# EasyEDA Pro project kuafu01_030内部老化方案.eprj, board PCB4 (continued)
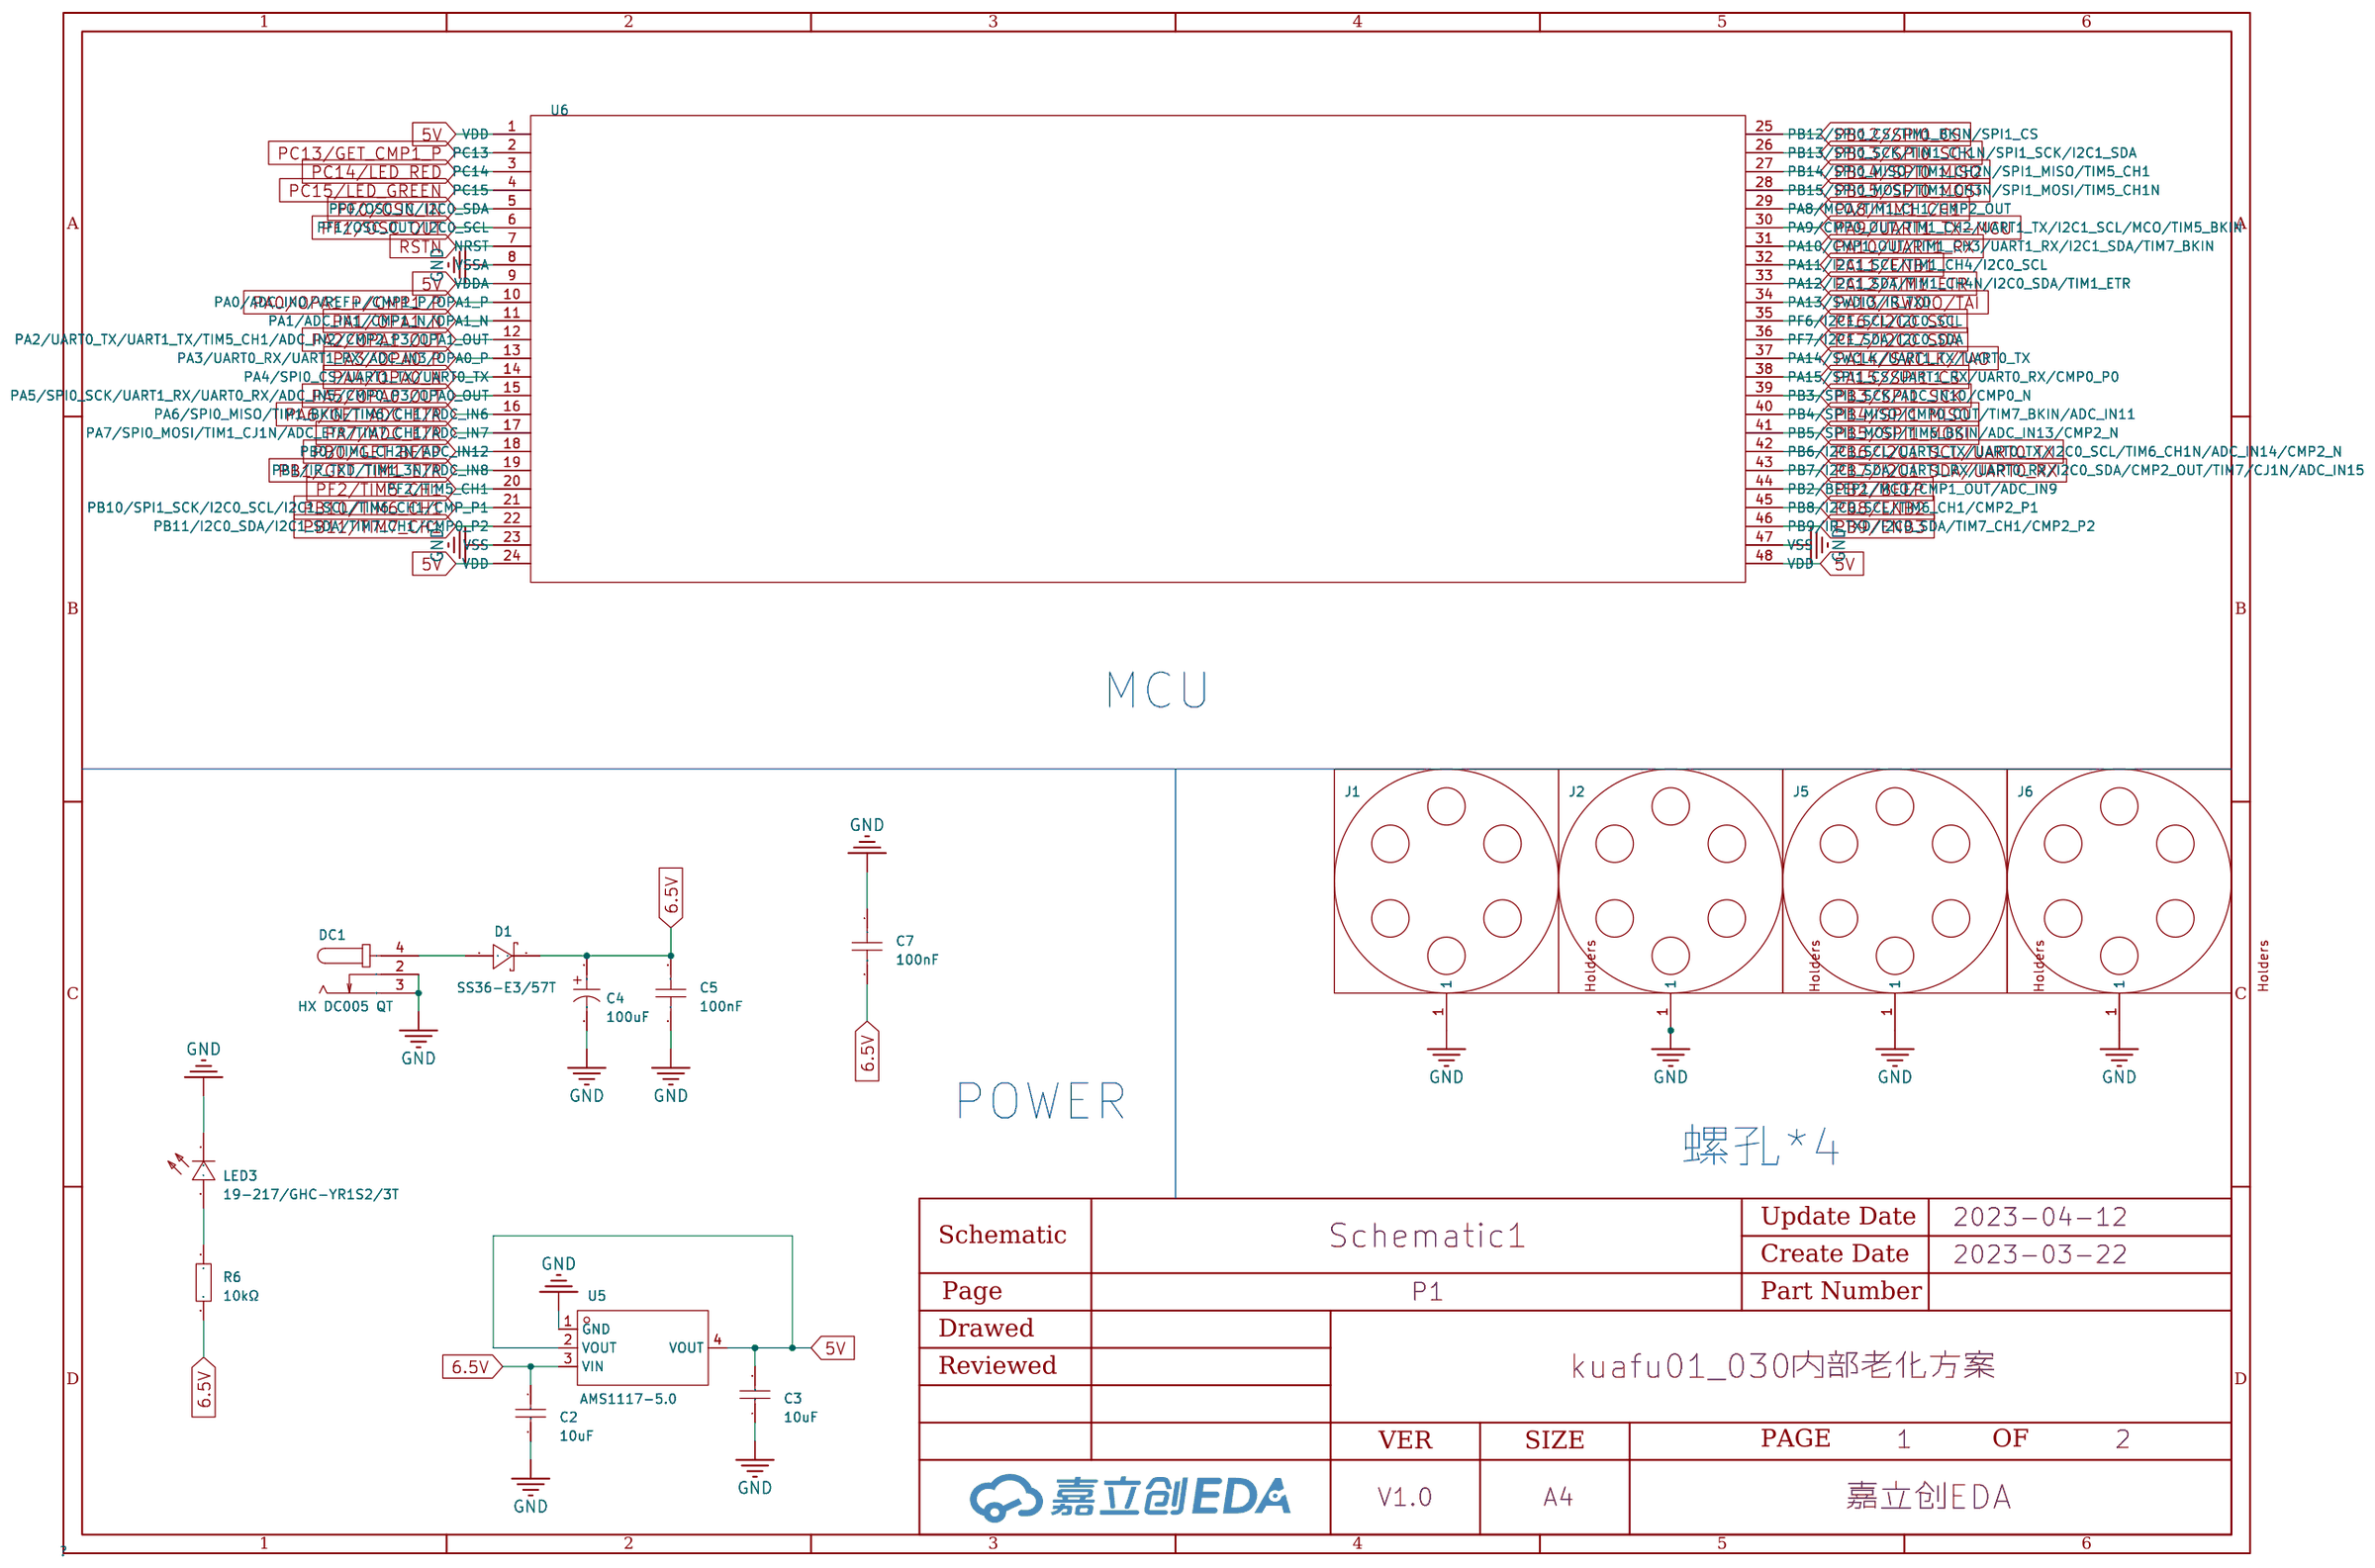
[diagram p0: P1]
## Routing (per net, layer and track width the routed paths; a pad name or vN(x,y) marks a point on that pad's centre or on a via; arc(x,y) is an arc through that point) (continued)
PA0/OPA1_P/CMP1_P: length 689
  Top Layer w0.254: 98.3,126.62 94.39,126.62 v1(92.8,125.03) ; v1(292.97,219.9) 292.45,220.41 292.45,221.8 292.62,221.97 ; v1(245.21,74.23) 246.79,75.82 250.7,75.82 ; v1(292.97,321.5) 292.45,322.01 292.45,323.4 292.62,323.57 ; v1(296,328.23) 297.59,329.82 301.5,329.82 ; v1(296,175.83) 297.59,177.42 301.5,177.42 ; v1(140.57,67.5) 140.05,68.01 140.05,69.4 140.22,69.57 ; 38.62,120.38 38.45,120.2 38.45,118.81 v1(38.97,118.3) ; v1(140.57,270.7) 140.05,271.21 140.05,272.6 140.22,272.77 ; v1(38.97,270.7) 38.45,271.21 38.45,272.6 38.62,272.77 ; 191.03,272.77 190.85,272.6 190.85,271.21 v1(191.37,270.7) ; 149.1,329.82 145.19,329.82 v1(143.6,328.23) ; v1(89.77,169.1) 89.25,169.62 89.25,171 89.42,171.17 ; 241.83,323.57 241.65,323.4 241.65,322.01 v1(242.17,321.5) ; v1(92.8,175.83) 94.39,177.42 98.3,177.42 ; v1(143.6,277.43) 145.19,279.02 149.1,279.02 ; 191.03,120.38 190.85,120.2 190.85,118.81 v1(191.37,118.3) ; 250.7,126.62 246.79,126.62 v1(245.21,125.03) ; 191.03,69.57 190.85,69.4 190.85,68.01 v1(191.37,67.5) ; v1(194.41,125.03) 195.99,126.62 199.9,126.62 ; v1(194.41,74.23) 195.99,75.82 199.9,75.82 ; v1(292.97,270.7) 292.45,271.21 292.45,272.6 292.62,272.77 ; 149.1,75.82 145.19,75.82 v1(143.6,74.23) ; 89.42,120.38 89.25,120.2 89.25,118.81 v1(89.77,118.3) ; 250.7,228.22 246.79,228.22 v1(245.21,226.63) ; 47.5,228.22 43.59,228.22 v1(42,226.63) ; 191.03,171.17 190.85,171 190.85,169.62 v1(191.37,169.1) ; 140.22,221.97 140.05,221.8 140.05,220.41 v1(140.57,219.9) ; v1(292.97,118.3) 292.45,118.81 292.45,120.2 292.62,120.38 ; 149.1,177.42 145.19,177.42 v1(143.6,175.83) ; v1(296,125.03) 297.59,126.62 301.5,126.62 ; 47.5,177.42 43.59,177.42 v1(42,175.83) ; v1(292.97,169.1) 292.45,169.62 292.45,171 292.62,171.17 ; v1(296,226.63) 297.59,228.22 301.5,228.22 ; v1(242.17,270.7) 241.65,271.21 241.65,272.6 241.83,272.77 ; 89.42,221.97 89.25,221.8 89.25,220.41 v1(89.77,219.9) ; 140.22,18.77 140.05,18.6 140.05,17.21 v1(140.57,16.7) ; v1(89.77,270.7) 89.25,271.21 89.25,272.6 89.42,272.77 ; v1(242.17,118.3) 241.65,118.81 241.65,120.2 241.83,120.38 ; v1(42,277.43) 43.59,279.02 47.5,279.02 ; v1(194.41,23.43) 195.99,25.02 199.9,25.02 ; v1(38.97,169.1) 38.45,169.62 38.45,171 38.62,171.17 ; v1(42,23.43) 43.59,25.02 47.5,25.02 ; 191.03,323.57 190.85,323.4 190.85,322.01 v1(191.37,321.5) ; v1(89.77,67.5) 89.25,68.01 89.25,69.4 89.42,69.57 ; 250.7,279.02 246.79,279.02 v1(245.21,277.43) ; v1(38.97,219.9) 38.45,220.41 38.45,221.8 38.62,221.97 ; v1(245.21,175.83) 246.79,177.42 250.7,177.42 ; v1(143.6,23.43) 145.19,25.02 149.1,25.02 ; 149.1,126.62 145.19,126.62 v1(143.6,125.03) ; v1(242.17,67.5) 241.65,68.01 241.65,69.4 241.83,69.57 ; 250.7,329.82 246.79,329.82 v1(245.21,328.23) ; v1(42,125.03) 43.59,126.62 47.5,126.62 ; 89.42,323.57 89.25,323.4 89.25,322.01 v1(89.77,321.5) ; v1(42,74.23) 43.59,75.82 47.5,75.82 ; 140.22,323.57 140.05,323.4 140.05,322.01 v1(140.57,321.5) ; v1(92.8,328.23) 94.39,329.82 98.3,329.82 ; v1(38.97,67.5) 38.45,68.01 38.45,69.4 38.62,69.57 ; v1(191.37,16.7) 190.85,17.21 190.85,18.6 191.03,18.77 ; v1(89.77,16.7) 89.25,17.21 89.25,18.6 89.42,18.77 ; 250.7,25.02 246.79,25.02 v1(245.21,23.43) ; 98.3,279.02 94.39,279.02 v1(92.8,277.43) ; v1(38.97,16.7) 38.45,17.21 38.45,18.6 38.62,18.77 ; 98.3,25.02 94.39,25.02 v1(92.8,23.43) ; 98.3,75.82 94.39,75.82 v1(92.8,74.23) ; v1(296,74.23) 297.59,75.82 301.5,75.82 ; v1(194.41,328.23) 195.99,329.82 199.9,329.82 ; 149.1,228.22 145.19,228.22 v1(143.6,226.63) ; v1(92.8,226.63) 94.39,228.22 98.3,228.22 ; v1(242.17,219.9) 241.65,220.41 241.65,221.8 241.83,221.97 ; v1(194.41,277.43) 195.99,279.02 199.9,279.02 ; 191.03,221.97 190.85,221.8 190.85,220.41 v1(191.37,219.9) ; 292.62,69.57 292.45,69.4 292.45,68.01 v1(292.97,67.5) ; 140.22,120.38 140.05,120.2 140.05,118.81 v1(140.57,118.3) ; v1(140.57,169.1) 140.05,169.62 140.05,171 140.22,171.17 ; 241.83,171.17 241.65,171 241.65,169.62 v1(242.17,169.1) ; v1(194.41,226.63) 195.99,228.22 199.9,228.22 ; v1(242.17,16.7) 241.65,17.21 241.65,18.6 241.83,18.77 ; 199.9,177.42 195.99,177.42 v1(194.41,175.83) ; 301.5,279.02 297.59,279.02 v1(296,277.43)
  Bottom Layer w0.254: v1(292.97,118.3) 294.19,118.3 294.76,118.86 294.76,123.79 v1(296,125.03) ; v1(92.8,277.43) 91.56,276.19 91.56,271.26 90.99,270.7 v1(89.77,270.7) ; v1(89.77,67.5) 90.99,67.5 91.56,68.06 91.56,72.99 v1(92.8,74.23) ; v1(245.21,23.43) 243.96,22.19 243.96,17.26 243.39,16.7 v1(242.17,16.7) ; v1(245.21,125.03) 243.96,123.79 243.96,118.86 243.39,118.3 v1(242.17,118.3) ; v1(38.97,169.1) 40.19,169.1 40.76,169.66 40.76,174.59 v1(42,175.83) ; v1(42,125.03) 40.76,123.79 40.76,118.86 40.19,118.3 v1(38.97,118.3) ; v1(191.37,321.5) 192.59,321.5 193.16,322.06 193.16,326.99 v1(194.41,328.23) ; v1(143.6,23.43) 142.36,22.19 142.36,17.26 141.79,16.7 v1(140.57,16.7) ; v1(191.37,270.7) 192.59,270.7 193.16,271.26 193.16,276.19 v1(194.41,277.43) ; v1(242.17,219.9) 243.39,219.9 243.96,220.46 243.96,225.39 v1(245.21,226.63) ; v1(296,277.43) 294.76,276.19 294.76,271.26 294.19,270.7 v1(292.97,270.7) ; v1(143.6,175.83) 142.36,174.59 142.36,169.66 141.79,169.1 v1(140.57,169.1) ; v1(292.97,67.5) 294.19,67.5 294.76,68.06 294.76,72.99 v1(296,74.23) ; v1(143.6,277.43) 142.36,276.19 142.36,271.26 141.79,270.7 v1(140.57,270.7) ; v1(140.57,67.5) 141.79,67.5 142.36,68.06 142.36,72.99 v1(143.6,74.23) ; v1(296,226.63) 294.76,225.39 294.76,220.46 294.19,219.9 v1(292.97,219.9) ; v1(89.77,169.1) 90.99,169.1 91.56,169.66 91.56,174.59 v1(92.8,175.83) ; v1(194.41,125.03) 193.16,123.79 193.16,118.86 192.59,118.3 v1(191.37,118.3) ; v1(92.8,226.63) 91.56,225.39 91.56,220.46 90.99,219.9 v1(89.77,219.9) ; v1(191.37,16.7) 192.59,16.7 193.16,17.26 193.16,22.19 v1(194.41,23.43) ; v1(292.97,321.5) 294.19,321.5 294.76,322.06 294.76,326.99 v1(296,328.23) ; v1(143.6,226.63) 142.36,225.39 142.36,220.46 141.79,219.9 v1(140.57,219.9) ; v1(89.77,118.3) 90.99,118.3 91.56,118.86 91.56,123.79 v1(92.8,125.03) ; v1(242.17,321.5) 243.39,321.5 243.96,322.06 243.96,326.99 v1(245.21,328.23) ; v1(292.97,169.1) 294.19,169.1 294.76,169.66 294.76,174.59 v1(296,175.83) ; v1(38.97,219.9) 40.19,219.9 40.76,220.46 40.76,225.39 v1(42,226.63) ; v1(38.97,16.7) 40.19,16.7 40.76,17.26 40.76,22.19 v1(42,23.43) ; v1(89.77,16.7) 90.99,16.7 91.56,17.26 91.56,22.19 v1(92.8,23.43) ; v1(92.8,328.23) 91.56,326.99 91.56,322.06 90.99,321.5 v1(89.77,321.5) ; v1(42,74.23) 40.76,72.99 40.76,68.06 40.19,67.5 v1(38.97,67.5) ; v1(143.6,125.03) 142.36,123.79 142.36,118.86 141.79,118.3 v1(140.57,118.3) ; v1(242.17,169.1) 243.39,169.1 243.96,169.66 243.96,174.59 v1(245.21,175.83) ; v1(140.57,321.5) 141.79,321.5 142.36,322.06 142.36,326.99 v1(143.6,328.23) ; v1(194.41,74.23) 193.16,72.99 193.16,68.06 192.59,67.5 v1(191.37,67.5) ; v1(38.97,270.7) 40.19,270.7 40.76,271.26 40.76,276.19 v1(42,277.43) ; v1(191.37,169.1) 192.59,169.1 193.16,169.66 193.16,174.59 v1(194.41,175.83) ; v1(242.17,270.7) 243.39,270.7 243.96,271.26 243.96,276.19 v1(245.21,277.43) ; v1(245.21,74.23) 243.96,72.99 243.96,68.06 243.39,67.5 v1(242.17,67.5) ; v1(194.41,226.63) 193.16,225.39 193.16,220.46 192.59,219.9 v1(191.37,219.9)
PA1/OPA1_N: length 19.9
  Top Layer w0.254: 250.63,176.9 250.63,176.41 ; 98.23,227.7 98.23,227.21 ; 199.83,176.9 199.83,176.41 ; 149.03,75.3 149.03,74.81 ; 149.03,278.5 149.03,278.01 ; 301.43,227.7 301.43,227.21 ; 149.03,24.5 149.03,24.01 ; 199.83,227.7 199.83,227.21 ; 98.23,75.3 98.23,74.81 ; 98.23,176.9 98.23,176.41 ; 47.43,176.9 47.43,176.41 ; 199.83,329.3 199.83,328.81 ; 250.63,75.3 250.63,74.81 ; 301.43,278.5 301.43,278.01 ; 47.43,75.3 47.43,74.81 ; 149.03,227.7 149.03,227.21 ; 199.83,24.5 199.83,24.01 ; 98.23,278.5 98.23,278.01 ; 199.83,126.1 199.83,125.61 ; 98.23,24.5 98.23,24.01 ; 250.63,329.3 250.63,328.81 ; 301.43,126.1 301.43,125.61 ; 199.83,75.3 199.83,74.81 ; 47.43,24.5 47.43,24.01 ; 47.43,278.5 47.43,278.01 ; 301.43,176.9 301.43,176.41 ; 98.23,126.1 98.23,125.61 ; 149.03,176.9 149.03,176.41 ; 250.63,24.5 250.63,24.01 ; 250.63,227.7 250.63,227.21 ; 199.83,278.5 199.83,278.01 ; 47.43,227.7 47.43,227.21 ; 98.23,329.3 98.23,328.81 ; 301.43,75.3 301.43,74.81 ; 149.03,329.3 149.03,328.81 ; 47.43,126.1 47.43,125.61 ; 250.63,278.5 250.63,278.01 ; 149.03,126.1 149.03,125.61 ; 301.43,329.3 301.43,328.81 ; 250.63,126.1 250.63,125.61
PA4/OPA0_N: length 20
  Top Layer w0.254: 253.08,327.36 253.08,327.35 252.59,327.35 ; 100.19,73.35 100.68,73.35 100.68,73.36 ; 201.79,73.35 202.28,73.35 202.28,73.36 ; 303.88,225.76 303.88,225.75 303.39,225.75 ; 150.99,327.35 151.48,327.35 151.48,327.36 ; 201.79,22.55 202.28,22.55 202.28,22.56 ; 100.19,276.55 100.68,276.55 100.68,276.56 ; 303.88,276.56 303.88,276.55 303.39,276.55 ; 151.48,73.36 151.48,73.35 150.99,73.35 ; 253.08,124.16 253.08,124.15 252.59,124.15 ; 100.68,327.36 100.68,327.35 100.19,327.35 ; 151.48,22.56 151.48,22.55 150.99,22.55 ; 253.08,22.56 253.08,22.55 252.59,22.55 ; 202.28,327.36 202.28,327.35 201.79,327.35 ; 303.88,73.36 303.88,73.35 303.39,73.35 ; 49.88,174.96 49.88,174.95 49.39,174.95 ; 150.99,174.95 151.48,174.95 151.48,174.96 ; 100.19,225.75 100.68,225.75 100.68,225.76 ; 100.68,22.56 100.68,22.55 100.19,22.55 ; 201.79,174.95 202.28,174.95 202.28,174.96 ; 202.28,225.76 202.28,225.75 201.79,225.75 ; 253.08,276.56 253.08,276.55 252.59,276.55 ; 49.88,276.56 49.88,276.55 49.39,276.55 ; 202.28,276.56 202.28,276.55 201.79,276.55 ; 150.99,124.15 151.48,124.15 151.48,124.16 ; 253.08,225.76 253.08,225.75 252.59,225.75 ; 49.39,73.35 49.88,73.35 49.88,73.36 ; 151.48,225.76 151.48,225.75 150.99,225.75 ; 252.59,174.95 253.08,174.95 253.08,174.96 ; 49.39,124.15 49.88,124.15 49.88,124.16 ; 49.39,22.55 49.88,22.55 49.88,22.56 ; 49.88,225.76 49.88,225.75 49.39,225.75 ; 150.99,276.55 151.48,276.55 151.48,276.56 ; 303.88,124.16 303.88,124.15 303.39,124.15 ; 253.08,73.36 253.08,73.35 252.59,73.35 ; 303.39,327.35 303.88,327.35 303.88,327.36 ; 100.19,174.95 100.68,174.95 100.68,174.96 ; 202.28,124.16 202.28,124.15 201.79,124.15 ; 100.68,124.16 100.68,124.15 100.19,124.15 ; 303.88,174.96 303.88,174.95 303.39,174.95
PA6/GET_ADC_ETR: length 20.1
  Top Layer w0.254: 151.98,73.35 152.48,73.35 152.48,73.36 ; 253.58,276.55 254.08,276.55 254.08,276.56 ; 151.98,225.75 152.48,225.75 152.48,225.76 ; 202.78,327.35 203.28,327.35 203.28,327.36 ; 304.38,276.55 304.88,276.55 304.88,276.56 ; 202.78,225.75 203.28,225.75 203.28,225.76 ; 50.88,22.56 50.88,22.55 50.38,22.55 ; 253.58,327.35 254.08,327.35 254.08,327.36 ; 151.98,22.55 152.48,22.55 152.48,22.56 ; 304.88,73.36 304.88,73.35 304.38,73.35 ; 101.18,124.15 101.68,124.15 101.68,124.16 ; 202.78,174.95 203.28,174.95 203.28,174.96 ; 101.68,73.36 101.68,73.35 101.18,73.35 ; 101.18,174.95 101.68,174.95 101.68,174.96 ; 50.38,174.95 50.88,174.95 50.88,174.96 ; 202.78,276.55 203.28,276.55 203.28,276.56 ; 253.58,174.95 254.08,174.95 254.08,174.96 ; 50.88,225.76 50.88,225.75 50.38,225.75 ; 50.88,124.16 50.88,124.15 50.38,124.15 ; 304.88,174.96 304.88,174.95 304.38,174.95 ; 202.78,124.15 203.28,124.15 203.28,124.16 ; 101.18,327.35 101.68,327.35 101.68,327.36 ; 304.38,124.15 304.88,124.15 304.88,124.16 ; 151.98,327.35 152.48,327.35 152.48,327.36 ; 203.28,73.36 203.28,73.35 202.78,73.35 ; 152.48,276.56 152.48,276.55 151.98,276.55 ; 50.88,276.56 50.88,276.55 50.38,276.55 ; 50.88,73.36 50.88,73.35 50.38,73.35 ; 304.38,327.35 304.88,327.35 304.88,327.36 ; 202.78,22.55 203.28,22.55 203.28,22.56 ; 254.08,225.76 254.08,225.75 253.58,225.75 ; 101.18,22.55 101.68,22.55 101.68,22.56 ; 253.58,22.55 254.08,22.55 254.08,22.56 ; 254.08,124.16 254.08,124.15 253.58,124.15 ; 101.68,225.76 101.68,225.75 101.18,225.75 ; 152.48,174.96 152.48,174.95 151.98,174.95 ; 304.38,225.75 304.88,225.75 304.88,225.76 ; 152.48,124.16 152.48,124.15 151.98,124.15 ; 101.68,276.56 101.68,276.55 101.18,276.55 ; 254.08,73.36 254.08,73.35 253.58,73.35
PA8/TIM1_CH1: length 3036.5
  Top Layer w0.254: 306.38,124.15 306.38,122.14 307.96,120.56 316.86,120.56 319.9,123.6 v1(319.9,124.36) 320.78,124.36 324.51,128.09 324.51,130.27 322.91,131.87 322.91,135.22 310.93,147.2 303.76,147.2 303.02,146.46 303.02,143.15 ; 208.22,229.2 216.29,229.2 v1(217.87,230.77) ; 201.42,92.35 201.42,95.66 202.16,96.4 209.33,96.4 221.31,84.42 221.31,81.07 222.91,79.47 222.91,77.29 219.18,73.56 v1(218.3,73.56) 218.3,72.8 215.26,69.76 206.36,69.76 204.78,71.34 204.78,73.35 ; 208.22,178.4 216.29,178.4 v1(217.87,179.97) ; v1(217.87,78.37) 216.29,76.8 208.22,76.8 ; 309.82,178.4 317.89,178.4 v1(319.47,179.97) ; v1(167.07,281.57) 165.49,280 157.42,280 ; 306.38,225.75 306.38,223.74 307.96,222.16 316.86,222.16 319.9,225.2 v1(319.9,225.96) 320.78,225.96 324.51,229.69 324.51,231.87 322.91,233.47 322.91,236.82 310.93,248.8 303.76,248.8 303.02,248.06 303.02,244.75 ; 153.98,276.55 153.98,274.54 155.56,272.96 164.46,272.96 167.5,276 v1(167.5,276.76) 168.38,276.76 172.11,280.49 172.11,282.67 170.51,284.27 170.51,287.62 158.53,299.6 151.36,299.6 150.62,298.86 150.62,295.55 ; 106.62,127.6 114.69,127.6 v1(116.27,129.17) ; v1(167.07,179.97) 165.49,178.4 157.42,178.4 ; v1(268.67,27.57) 267.09,26 259.02,26 ; 303.02,92.35 303.02,95.66 303.76,96.4 310.93,96.4 322.91,84.42 322.91,81.07 324.51,79.47 324.51,77.29 320.78,73.56 v1(319.9,73.56) 319.9,72.8 316.86,69.76 307.96,69.76 306.38,71.34 306.38,73.35 ; 99.82,92.35 99.82,95.66 100.56,96.4 107.73,96.4 119.71,84.42 119.71,81.07 121.31,79.47 121.31,77.29 117.58,73.56 v1(116.7,73.56) 116.7,72.8 113.66,69.76 104.76,69.76 103.18,71.34 103.18,73.35 ; 49.02,295.55 49.02,298.86 49.76,299.6 56.93,299.6 68.91,287.62 68.91,284.27 70.51,282.67 70.51,280.49 66.78,276.76 v1(65.9,276.76) 65.9,276 62.86,272.96 53.96,272.96 52.38,274.54 52.38,276.55 ; 306.38,174.95 306.38,172.94 307.96,171.36 316.86,171.36 319.9,174.4 v1(319.9,175.16) 320.78,175.16 324.51,178.89 324.51,181.07 322.91,182.67 322.91,186.02 310.93,198 303.76,198 303.02,197.26 303.02,193.95 ; v1(116.27,27.57) 114.69,26 106.62,26 ; 255.58,174.95 255.58,172.94 257.16,171.36 266.06,171.36 269.1,174.4 v1(269.1,175.16) 269.98,175.16 273.71,178.89 273.71,181.07 272.11,182.67 272.11,186.02 260.13,198 252.96,198 252.22,197.26 252.22,193.95 ; 49.02,41.55 49.02,44.86 49.76,45.6 56.93,45.6 68.91,33.62 68.91,30.27 70.51,28.67 70.51,26.49 66.78,22.76 v1(65.9,22.76) 65.9,22 62.86,18.96 53.96,18.96 52.38,20.54 52.38,22.55 ; v1(167.07,27.57) 165.49,26 157.42,26 ; 252.22,295.55 252.22,298.86 252.96,299.6 260.13,299.6 272.11,287.62 272.11,284.27 273.71,282.67 273.71,280.49 269.98,276.76 v1(269.1,276.76) 269.1,276 266.06,272.96 257.16,272.96 255.58,274.54 255.58,276.55 ; v1(268.67,129.17) 267.09,127.6 259.02,127.6 ; 103.18,225.75 103.18,223.74 104.76,222.16 113.66,222.16 116.7,225.2 v1(116.7,225.96) 117.58,225.96 121.31,229.69 121.31,231.87 119.71,233.47 119.71,236.82 107.73,248.8 100.56,248.8 99.82,248.06 99.82,244.75 ; v1(116.27,332.37) 114.69,330.8 106.62,330.8 ; 309.82,127.6 317.89,127.6 v1(319.47,129.17) ; v1(167.07,78.37) 165.49,76.8 157.42,76.8 ; 208.22,127.6 216.29,127.6 v1(217.87,129.17) ; 208.22,26 216.29,26 v1(217.87,27.57) ; 55.82,229.2 63.89,229.2 v1(65.47,230.77) ; v1(319.47,230.77) 317.89,229.2 309.82,229.2 ; 201.42,41.55 201.42,44.86 202.16,45.6 209.33,45.6 221.31,33.62 221.31,30.27 222.91,28.67 222.91,26.49 219.18,22.76 v1(218.3,22.76) 218.3,22 215.26,18.96 206.36,18.96 204.78,20.54 204.78,22.55 ; 259.02,76.8 267.09,76.8 v1(268.67,78.37) ; 150.62,193.95 150.62,197.26 151.36,198 158.53,198 170.51,186.02 170.51,182.67 172.11,181.07 172.11,178.89 168.38,175.16 v1(167.5,175.16) 167.5,174.4 164.46,171.36 155.56,171.36 153.98,172.94 153.98,174.95 ; 55.82,76.8 63.89,76.8 v1(65.47,78.37) ; 55.82,26 63.89,26 v1(65.47,27.57) ; 309.82,330.8 317.89,330.8 v1(319.47,332.37) ; 106.62,229.2 114.69,229.2 v1(116.27,230.77) ; v1(217.87,332.37) 216.29,330.8 208.22,330.8 ; 153.98,124.15 153.98,122.14 155.56,120.56 164.46,120.56 167.5,123.6 v1(167.5,124.36) 168.38,124.36 172.11,128.09 172.11,130.27 170.51,131.87 170.51,135.22 158.53,147.2 151.36,147.2 150.62,146.46 150.62,143.15 ; 259.02,280 267.09,280 v1(268.67,281.57) ; 252.22,41.55 252.22,44.86 252.96,45.6 260.13,45.6 272.11,33.62 272.11,30.27 273.71,28.67 273.71,26.49 269.98,22.76 v1(269.1,22.76) 269.1,22 266.06,18.96 257.16,18.96 255.58,20.54 255.58,22.55 ; v1(319.47,78.37) 317.89,76.8 309.82,76.8 ; v1(116.27,179.97) 114.69,178.4 106.62,178.4 ; 157.42,330.8 165.49,330.8 v1(167.07,332.37) ; 204.78,174.95 204.78,172.94 206.36,171.36 215.26,171.36 218.3,174.4 v1(218.3,175.16) 219.18,175.16 222.91,178.89 222.91,181.07 221.31,182.67 221.31,186.02 209.33,198 202.16,198 201.42,197.26 201.42,193.95 ; v1(167.07,230.77) 165.49,229.2 157.42,229.2 ; 153.98,73.35 153.98,71.34 155.56,69.76 164.46,69.76 167.5,72.8 v1(167.5,73.56) 168.38,73.56 172.11,77.29 172.11,79.47 170.51,81.07 170.51,84.42 158.53,96.4 151.36,96.4 150.62,95.66 150.62,92.35 ; 201.42,346.35 201.42,349.66 202.16,350.4 209.33,350.4 221.31,338.42 221.31,335.07 222.91,333.47 222.91,331.29 219.18,327.56 v1(218.3,327.56) 218.3,326.8 215.26,323.76 206.36,323.76 204.78,325.34 204.78,327.35 ; 252.22,244.75 252.22,248.06 252.96,248.8 260.13,248.8 272.11,236.82 272.11,233.47 273.71,231.87 273.71,229.69 269.98,225.96 v1(269.1,225.96) 269.1,225.2 266.06,222.16 257.16,222.16 255.58,223.74 255.58,225.75 ; 201.42,295.55 201.42,298.86 202.16,299.6 209.33,299.6 221.31,287.62 221.31,284.27 222.91,282.67 222.91,280.49 219.18,276.76 v1(218.3,276.76) 218.3,276 215.26,272.96 206.36,272.96 204.78,274.54 204.78,276.55 ; v1(319.47,281.57) 317.89,280 309.82,280 ; 103.18,276.55 103.18,274.54 104.76,272.96 113.66,272.96 116.7,276 v1(116.7,276.76) 117.58,276.76 121.31,280.49 121.31,282.67 119.71,284.27 119.71,287.62 107.73,299.6 100.56,299.6 99.82,298.86 99.82,295.55 ; 52.38,73.35 52.38,71.34 53.96,69.76 62.86,69.76 65.9,72.8 v1(65.9,73.56) 66.78,73.56 70.51,77.29 70.51,79.47 68.91,81.07 68.91,84.42 56.93,96.4 49.76,96.4 49.02,95.66 49.02,92.35 ; 99.82,41.55 99.82,44.86 100.56,45.6 107.73,45.6 119.71,33.62 119.71,30.27 121.31,28.67 121.31,26.49 117.58,22.76 v1(116.7,22.76) 116.7,22 113.66,18.96 104.76,18.96 103.18,20.54 103.18,22.55 ; 204.78,124.15 204.78,122.14 206.36,120.56 215.26,120.56 218.3,123.6 v1(218.3,124.36) 219.18,124.36 222.91,128.09 222.91,130.27 221.31,131.87 221.31,135.22 209.33,147.2 202.16,147.2 201.42,146.46 201.42,143.15 ; 103.18,124.15 103.18,122.14 104.76,120.56 113.66,120.56 116.7,123.6 v1(116.7,124.36) 117.58,124.36 121.31,128.09 121.31,130.27 119.71,131.87 119.71,135.22 107.73,147.2 100.56,147.2 99.82,146.46 99.82,143.15 ; v1(268.67,230.77) 267.09,229.2 259.02,229.2 ; v1(268.67,179.97) 267.09,178.4 259.02,178.4 ; 255.58,73.35 255.58,71.34 257.16,69.76 266.06,69.76 269.1,72.8 v1(269.1,73.56) 269.98,73.56 273.71,77.29 273.71,79.47 272.11,81.07 272.11,84.42 260.13,96.4 252.96,96.4 252.22,95.66 252.22,92.35 ; v1(217.87,281.57) 216.29,280 208.22,280 ; 150.62,346.35 150.62,349.66 151.36,350.4 158.53,350.4 170.51,338.42 170.51,335.07 172.11,333.47 172.11,331.29 168.38,327.56 v1(167.5,327.56) 167.5,326.8 164.46,323.76 155.56,323.76 153.98,325.34 153.98,327.35 ; v1(65.47,179.97) 63.89,178.4 55.82,178.4 ; 153.98,22.55 153.98,20.54 155.56,18.96 164.46,18.96 167.5,22 v1(167.5,22.76) 168.38,22.76 172.11,26.49 172.11,28.67 170.51,30.27 170.51,33.62 158.53,45.6 151.36,45.6 150.62,44.86 150.62,41.55 ; 255.58,327.35 255.58,325.34 257.16,323.76 266.06,323.76 269.1,326.8 v1(269.1,327.56) 269.98,327.56 273.71,331.29 273.71,333.47 272.11,335.07 272.11,338.42 260.13,350.4 252.96,350.4 252.22,349.66 252.22,346.35 ; 52.38,124.15 52.38,122.14 53.96,120.56 62.86,120.56 65.9,123.6 v1(65.9,124.36) 66.78,124.36 70.51,128.09 70.51,130.27 68.91,131.87 68.91,135.22 56.93,147.2 49.76,147.2 49.02,146.46 49.02,143.15 ; 55.82,127.6 63.89,127.6 v1(65.47,129.17) ; 306.38,276.55 306.38,274.54 307.96,272.96 316.86,272.96 319.9,276 v1(319.9,276.76) 320.78,276.76 324.51,280.49 324.51,282.67 322.91,284.27 322.91,287.62 310.93,299.6 303.76,299.6 303.02,298.86 303.02,295.55 ; 52.38,225.75 52.38,223.74 53.96,222.16 62.86,222.16 65.9,225.2 v1(65.9,225.96) 66.78,225.96 70.51,229.69 70.51,231.87 68.91,233.47 68.91,236.82 56.93,248.8 49.76,248.8 49.02,248.06 49.02,244.75 ; 106.62,280 114.69,280 v1(116.27,281.57) ; 303.02,346.35 303.02,349.66 303.76,350.4 310.93,350.4 322.91,338.42 322.91,335.07 324.51,333.47 324.51,331.29 320.78,327.56 v1(319.9,327.56) 319.9,326.8 316.86,323.76 307.96,323.76 306.38,325.34 306.38,327.35 ; v1(167.07,129.17) 165.49,127.6 157.42,127.6 ; v1(116.27,78.37) 114.69,76.8 106.62,76.8 ; 103.18,327.35 103.18,325.34 104.76,323.76 113.66,323.76 116.7,326.8 v1(116.7,327.56) 117.58,327.56 121.31,331.29 121.31,333.47 119.71,335.07 119.71,338.42 107.73,350.4 100.56,350.4 99.82,349.66 99.82,346.35 ; 201.42,244.75 201.42,248.06 202.16,248.8 209.33,248.8 221.31,236.82 221.31,233.47 222.91,231.87 222.91,229.69 219.18,225.96 v1(218.3,225.96) 218.3,225.2 215.26,222.16 206.36,222.16 204.78,223.74 204.78,225.75 ; 49.02,193.95 49.02,197.26 49.76,198 56.93,198 68.91,186.02 68.91,182.67 70.51,181.07 70.51,178.89 66.78,175.16 v1(65.9,175.16) 65.9,174.4 62.86,171.36 53.96,171.36 52.38,172.94 52.38,174.95 ; 103.18,174.95 103.18,172.94 104.76,171.36 113.66,171.36 116.7,174.4 v1(116.7,175.16) 117.58,175.16 121.31,178.89 121.31,181.07 119.71,182.67 119.71,186.02 107.73,198 100.56,198 99.82,197.26 99.82,193.95 ; v1(65.47,281.57) 63.89,280 55.82,280 ; v1(268.67,332.37) 267.09,330.8 259.02,330.8 ; 150.62,244.75 150.62,248.06 151.36,248.8 158.53,248.8 170.51,236.82 170.51,233.47 172.11,231.87 172.11,229.69 168.38,225.96 v1(167.5,225.96) 167.5,225.2 164.46,222.16 155.56,222.16 153.98,223.74 153.98,225.75 ; 255.58,124.15 255.58,122.14 257.16,120.56 266.06,120.56 269.1,123.6 v1(269.1,124.36) 269.98,124.36 273.71,128.09 273.71,130.27 272.11,131.87 272.11,135.22 260.13,147.2 252.96,147.2 252.22,146.46 252.22,143.15
  Bottom Layer w0.254: v1(65.47,230.77) 65.77,230.48 65.77,226.08 v1(65.9,225.96) ; v1(167.07,179.97) 167.37,179.68 167.37,175.28 v1(167.5,175.16) ; v1(65.9,73.56) 65.77,73.68 65.77,78.08 v1(65.47,78.37) ; v1(116.27,129.17) 116.57,128.88 116.57,124.48 v1(116.7,124.36) ; v1(116.27,27.57) 116.57,27.28 116.57,22.88 v1(116.7,22.76) ; v1(218.3,276.76) 218.17,276.88 218.17,281.28 v1(217.87,281.57) ; v1(319.47,129.17) 319.77,128.88 319.77,124.48 v1(319.9,124.36) ; v1(116.27,230.77) 116.57,230.48 116.57,226.08 v1(116.7,225.96) ; v1(167.5,327.56) 167.37,327.68 167.37,332.08 v1(167.07,332.37) ; v1(218.3,124.36) 218.17,124.48 218.17,128.88 v1(217.87,129.17) ; v1(116.7,276.76) 116.57,276.88 116.57,281.28 v1(116.27,281.57) ; v1(319.47,78.37) 319.77,78.08 319.77,73.68 v1(319.9,73.56) ; v1(218.3,175.16) 218.17,175.28 218.17,179.68 v1(217.87,179.97) ; v1(319.47,230.77) 319.77,230.48 319.77,226.08 v1(319.9,225.96) ; v1(167.07,129.17) 167.37,128.88 167.37,124.48 v1(167.5,124.36) ; v1(65.9,276.76) 65.77,276.88 65.77,281.28 v1(65.47,281.57) ; v1(269.1,73.56) 268.97,73.68 268.97,78.08 v1(268.67,78.37) ; v1(217.87,27.57) 218.17,27.28 218.17,22.88 v1(218.3,22.76) ; v1(116.27,332.37) 116.57,332.08 116.57,327.68 v1(116.7,327.56) ; v1(217.87,332.37) 218.17,332.08 218.17,327.68 v1(218.3,327.56) ; v1(65.47,27.57) 65.77,27.28 65.77,22.88 v1(65.9,22.76) ; v1(65.9,175.16) 65.77,175.28 65.77,179.68 v1(65.47,179.97) ; v1(269.1,327.56) 268.97,327.68 268.97,332.08 v1(268.67,332.37) ; v1(116.27,179.97) 116.57,179.68 116.57,175.28 v1(116.7,175.16) ; v1(167.07,230.77) 167.37,230.48 167.37,226.08 v1(167.5,225.96) ; v1(319.9,276.76) 319.77,276.88 319.77,281.28 v1(319.47,281.57) ; v1(268.67,179.97) 268.97,179.68 268.97,175.28 v1(269.1,175.16) ; v1(269.1,225.96) 268.97,226.08 268.97,230.48 v1(268.67,230.77) ; v1(319.47,332.37) 319.77,332.08 319.77,327.68 v1(319.9,327.56) ; v1(268.67,129.17) 268.97,128.88 268.97,124.48 v1(269.1,124.36) ; v1(116.27,78.37) 116.57,78.08 116.57,73.68 v1(116.7,73.56) ; v1(319.9,175.16) 319.77,175.28 319.77,179.68 v1(319.47,179.97) ; v1(65.9,124.36) 65.77,124.48 65.77,128.88 v1(65.47,129.17) ; v1(167.5,276.76) 167.37,276.88 167.37,281.28 v1(167.07,281.57) ; v1(167.07,27.57) 167.37,27.28 167.37,22.88 v1(167.5,22.76) ; v1(268.67,281.57) 268.97,281.28 268.97,276.88 v1(269.1,276.76) ; v1(217.87,78.37) 218.17,78.08 218.17,73.68 v1(218.3,73.56) ; v1(268.67,27.57) 268.97,27.28 268.97,22.88 v1(269.1,22.76) ; v1(167.5,73.56) 167.37,73.68 167.37,78.08 v1(167.07,78.37) ; v1(218.3,225.96) 218.17,226.08 218.17,230.48 v1(217.87,230.77)
PA9/UART1_TX-1551B: length 389.3
  Top Layer w0.254: 95.67,289.19 92.5,289.19 87.86,293.83 ; 291.06,293.83 295.7,289.19 298.87,289.19 ; 298.87,85.99 295.7,85.99 291.06,90.63 ; 240.26,344.63 244.9,339.99 248.07,339.99 ; 291.06,192.23 295.7,187.59 298.87,187.59 ; 197.27,136.79 194.1,136.79 189.46,141.43 ; 44.87,35.19 41.7,35.19 37.06,39.83 ; 189.46,39.83 194.1,35.19 197.27,35.19 ; 240.26,192.23 244.9,187.59 248.07,187.59 ; 197.27,85.99 194.1,85.99 189.46,90.63 ; 146.47,339.99 143.3,339.99 138.66,344.63 ; 291.06,344.63 295.7,339.99 298.87,339.99 ; 189.46,293.83 194.1,289.19 197.27,289.19 ; 197.27,339.99 194.1,339.99 189.46,344.63 ; 87.86,344.63 92.5,339.99 95.67,339.99 ; 197.27,238.39 194.1,238.39 189.46,243.03 ; 146.47,238.39 143.3,238.39 138.66,243.03 ; 138.66,141.43 143.3,136.79 146.47,136.79 ; 44.87,238.39 41.7,238.39 37.06,243.03 ; 298.87,136.79 295.7,136.79 291.06,141.43 ; 138.66,192.23 143.3,187.59 146.47,187.59 ; 95.67,136.79 92.5,136.79 87.86,141.43 ; 240.26,293.83 244.9,289.19 248.07,289.19 ; 37.06,293.83 41.7,289.19 44.87,289.19 ; 87.86,192.23 92.5,187.59 95.67,187.59 ; 146.47,85.99 143.3,85.99 138.66,90.63 ; 189.46,192.23 194.1,187.59 197.27,187.59 ; 44.87,85.99 41.7,85.99 37.06,90.63 ; 37.06,192.23 41.7,187.59 44.87,187.59 ; 248.07,35.19 244.9,35.19 240.26,39.83 ; 248.07,136.79 244.9,136.79 240.26,141.43 ; 248.07,85.99 244.9,85.99 240.26,90.63 ; 95.67,35.19 92.5,35.19 87.86,39.83 ; 146.47,35.19 143.3,35.19 138.66,39.83 ; 138.66,293.83 143.3,289.19 146.47,289.19 ; 95.67,85.99 92.5,85.99 87.86,90.63 ; 87.86,243.03 92.5,238.39 95.67,238.39 ; 291.06,243.03 295.7,238.39 298.87,238.39 ; 37.06,141.43 41.7,136.79 44.87,136.79 ; 240.26,243.03 244.9,238.39 248.07,238.39
PA9/UART1_TX-MCU: length 3764.5
  Top Layer w0.254: 291.12,194.63 291.12,196.41 301.31,206.6 310.71,206.6 v1(313.4,203.92) ; v1(213.67,87.88) 213.77,87.98 213.77,89.99 210,93.76 207.96,93.76 206.64,92.44 ; v1(272.31,231.08) 271.83,230.6 270.74,230.6 269.64,231.7 v1(269.12,231.7) 268.55,231.7 266.53,229.69 259.09,229.69 ; v1(264.47,138.67) 264.57,138.78 264.57,140.79 260.8,144.56 258.76,144.56 257.44,143.24 ; 155.84,295.64 157.16,296.96 159.2,296.96 162.97,293.19 162.97,291.18 v1(162.87,291.07) ; v1(323.12,332.68) 322.63,332.2 321.54,332.2 320.44,333.3 v1(319.92,333.3) 319.35,333.3 317.33,331.29 309.89,331.29 ; v1(323.12,78.68) 322.63,78.2 321.54,78.2 320.44,79.3 v1(319.92,79.3) 319.35,79.3 317.33,77.29 309.89,77.29 ; v1(262.6,51.52) 259.91,54.2 250.51,54.2 240.32,44.01 240.32,42.23 ; 240.32,143.83 240.32,145.61 250.51,155.8 259.91,155.8 v1(262.6,153.12) ; v1(110.2,254.72) 107.51,257.4 98.11,257.4 87.92,247.21 87.92,245.43 ; 106.69,229.69 114.13,229.69 116.15,231.7 v1(116.72,231.7) 117.24,231.7 118.34,230.6 119.43,230.6 v1(119.91,231.08) ; v1(264.47,189.47) 264.57,189.58 264.57,191.59 260.8,195.36 258.76,195.36 257.44,194.04 ; 208.29,128.09 215.73,128.09 217.75,130.1 v1(218.32,130.1) 218.84,130.1 219.94,129 221.03,129 v1(221.52,129.48) ; v1(161,51.52) 158.31,54.2 148.91,54.2 138.72,44.01 138.72,42.23 ; 189.52,296.23 189.52,298.01 199.71,308.2 209.11,308.2 v1(211.8,305.52) ; 189.52,42.23 189.52,44.01 199.71,54.2 209.11,54.2 v1(211.8,51.52) ; 189.52,194.63 189.52,196.41 199.71,206.6 209.11,206.6 v1(211.8,203.92) ; v1(323.12,129.48) 322.63,129 321.54,129 320.44,130.1 v1(319.92,130.1) 319.35,130.1 317.33,128.09 309.89,128.09 ; v1(161,102.32) 158.31,105 148.91,105 138.72,94.81 138.72,93.03 ; v1(59.4,254.72) 56.71,257.4 47.31,257.4 37.12,247.21 37.12,245.43 ; 55.89,178.89 63.33,178.89 65.35,180.9 v1(65.92,180.9) 66.44,180.9 67.54,179.8 68.63,179.8 v1(69.11,180.28) ; v1(315.27,240.27) 315.37,240.38 315.37,242.39 311.6,246.16 309.56,246.16 308.24,244.84 ; v1(213.67,138.67) 213.77,138.78 213.77,140.79 210,144.56 207.96,144.56 206.64,143.24 ; 87.92,347.03 87.92,348.81 98.11,359 107.51,359 v1(110.2,356.32) ; v1(211.8,254.72) 209.11,257.4 199.71,257.4 189.52,247.21 189.52,245.43 ; v1(61.27,240.27) 61.37,240.38 61.37,242.39 57.6,246.16 55.56,246.16 54.24,244.84 ; v1(69.11,129.48) 68.63,129 67.54,129 66.44,130.1 v1(65.92,130.1) 65.35,130.1 63.33,128.09 55.89,128.09 ; v1(69.11,281.88) 68.63,281.4 67.54,281.4 66.44,282.5 v1(65.92,282.5) 65.35,282.5 63.33,280.49 55.89,280.49 ; 138.72,143.83 138.72,145.61 148.91,155.8 158.31,155.8 v1(161,153.12) ; v1(162.87,240.27) 162.97,240.38 162.97,242.39 159.2,246.16 157.16,246.16 155.84,244.84 ; v1(315.27,189.47) 315.37,189.58 315.37,191.59 311.6,195.36 309.56,195.36 308.24,194.04 ; v1(112.07,291.07) 112.17,291.18 112.17,293.19 108.4,296.96 106.36,296.96 105.04,295.64 ; v1(262.6,254.72) 259.91,257.4 250.51,257.4 240.32,247.21 240.32,245.43 ; v1(170.72,129.48) 170.23,129 169.14,129 168.04,130.1 v1(167.52,130.1) 166.95,130.1 164.93,128.09 157.49,128.09 ; v1(213.67,37.07) 213.77,37.18 213.77,39.19 210,42.96 207.96,42.96 206.64,41.64 ; 206.64,346.44 207.96,347.76 210,347.76 213.77,343.99 213.77,341.98 v1(213.67,341.88) ; v1(264.47,291.07) 264.57,291.18 264.57,293.19 260.8,296.96 258.76,296.96 257.44,295.64 ; 157.49,331.29 164.93,331.29 166.95,333.3 v1(167.52,333.3) 168.04,333.3 169.14,332.2 170.23,332.2 v1(170.72,332.68) ; 37.12,194.63 37.12,196.41 47.31,206.6 56.71,206.6 v1(59.4,203.92) ; v1(110.2,203.92) 107.51,206.6 98.11,206.6 87.92,196.41 87.92,194.63 ; v1(161,305.52) 158.31,308.2 148.91,308.2 138.72,298.01 138.72,296.23 ; v1(313.4,305.52) 310.71,308.2 301.31,308.2 291.12,298.01 291.12,296.23 ; 54.24,92.44 55.56,93.76 57.6,93.76 61.37,89.99 61.37,87.98 v1(61.27,87.88) ; v1(161,254.72) 158.31,257.4 148.91,257.4 138.72,247.21 138.72,245.43 ; v1(211.8,356.32) 209.11,359 199.71,359 189.52,348.81 189.52,347.03 ; 87.92,296.23 87.92,298.01 98.11,308.2 107.51,308.2 v1(110.2,305.52) ; 291.12,93.03 291.12,94.81 301.31,105 310.71,105 v1(313.4,102.32) ; 259.09,26.49 266.53,26.49 268.55,28.5 v1(269.12,28.5) 269.64,28.5 270.74,27.4 271.83,27.4 v1(272.31,27.88) ; 155.84,92.44 157.16,93.76 159.2,93.76 162.97,89.99 162.97,87.98 v1(162.87,87.88) ; v1(59.4,305.52) 56.71,308.2 47.31,308.2 37.12,298.01 37.12,296.23 ; 54.24,41.64 55.56,42.96 57.6,42.96 61.37,39.19 61.37,37.18 v1(61.27,37.07) ; v1(119.91,332.68) 119.43,332.2 118.34,332.2 117.24,333.3 v1(116.72,333.3) 116.15,333.3 114.13,331.29 106.69,331.29 ; 54.24,194.04 55.56,195.36 57.6,195.36 61.37,191.59 61.37,189.58 v1(61.27,189.47) ; 257.44,346.44 258.76,347.76 260.8,347.76 264.57,343.99 264.57,341.98 v1(264.47,341.88) ; v1(112.07,240.27) 112.17,240.38 112.17,242.39 108.4,246.16 106.36,246.16 105.04,244.84 ; 54.24,295.64 55.56,296.96 57.6,296.96 61.37,293.19 61.37,291.18 v1(61.27,291.07) ; 309.89,280.49 317.33,280.49 319.35,282.5 v1(319.92,282.5) 320.44,282.5 321.54,281.4 322.63,281.4 v1(323.12,281.88) ; 208.29,178.89 215.73,178.89 217.75,180.9 v1(218.32,180.9) 218.84,180.9 219.94,179.8 221.03,179.8 v1(221.52,180.28) ; v1(59.4,51.52) 56.71,54.2 47.31,54.2 37.12,44.01 37.12,42.23 ; 259.09,128.09 266.53,128.09 268.55,130.1 v1(269.12,130.1) 269.64,130.1 270.74,129 271.83,129 v1(272.31,129.48) ; 208.29,331.29 215.73,331.29 217.75,333.3 v1(218.32,333.3) 218.84,333.3 219.94,332.2 221.03,332.2 v1(221.52,332.68) ; 37.12,143.83 37.12,145.61 47.31,155.8 56.71,155.8 v1(59.4,153.12) ; v1(221.52,27.88) 221.03,27.4 219.94,27.4 218.84,28.5 v1(218.32,28.5) 217.75,28.5 215.73,26.49 208.29,26.49 ; 37.12,93.03 37.12,94.81 47.31,105 56.71,105 v1(59.4,102.32) ; 106.69,26.49 114.13,26.49 116.15,28.5 v1(116.72,28.5) 117.24,28.5 118.34,27.4 119.43,27.4 v1(119.91,27.88) ; 240.32,194.63 240.32,196.41 250.51,206.6 259.91,206.6 v1(262.6,203.92) ; 309.89,229.69 317.33,229.69 319.35,231.7 v1(319.92,231.7) 320.44,231.7 321.54,230.6 322.63,230.6 v1(323.12,231.08) ; v1(170.72,231.08) 170.23,230.6 169.14,230.6 168.04,231.7 v1(167.52,231.7) 166.95,231.7 164.93,229.69 157.49,229.69 ; v1(262.6,305.52) 259.91,308.2 250.51,308.2 240.32,298.01 240.32,296.23 ; 106.69,77.29 114.13,77.29 116.15,79.3 v1(116.72,79.3) 117.24,79.3 118.34,78.2 119.43,78.2 v1(119.91,78.68) ; 259.09,77.29 266.53,77.29 268.55,79.3 v1(269.12,79.3) 269.64,79.3 270.74,78.2 271.83,78.2 v1(272.31,78.68) ; 308.24,295.64 309.56,296.96 311.6,296.96 315.37,293.19 315.37,291.18 v1(315.27,291.07) ; v1(211.8,102.32) 209.11,105 199.71,105 189.52,94.81 189.52,93.03 ; 55.89,77.29 63.33,77.29 65.35,79.3 v1(65.92,79.3) 66.44,79.3 67.54,78.2 68.63,78.2 v1(69.11,78.68) ; 308.24,92.44 309.56,93.76 311.6,93.76 315.37,89.99 315.37,87.98 v1(315.27,87.88) ; 155.84,41.64 157.16,42.96 159.2,42.96 162.97,39.19 162.97,37.18 v1(162.87,37.07) ; 105.04,41.64 106.36,42.96 108.4,42.96 112.17,39.19 112.17,37.18 v1(112.07,37.07) ; v1(110.2,153.12) 107.51,155.8 98.11,155.8 87.92,145.61 87.92,143.83 ; 105.04,143.24 106.36,144.56 108.4,144.56 112.17,140.79 112.17,138.78 v1(112.07,138.67) ; 87.92,93.03 87.92,94.81 98.11,105 107.51,105 v1(110.2,102.32) ; v1(213.67,240.27) 213.77,240.38 213.77,242.39 210,246.16 207.96,246.16 206.64,244.84 ; v1(221.52,78.68) 221.03,78.2 219.94,78.2 218.84,79.3 v1(218.32,79.3) 217.75,79.3 215.73,77.29 208.29,77.29 ; v1(213.67,189.47) 213.77,189.58 213.77,191.59 210,195.36 207.96,195.36 206.64,194.04 ; 309.89,178.89 317.33,178.89 319.35,180.9 v1(319.92,180.9) 320.44,180.9 321.54,179.8 322.63,179.8 v1(323.12,180.28) ; v1(170.72,78.68) 170.23,78.2 169.14,78.2 168.04,79.3 v1(167.52,79.3) 166.95,79.3 164.93,77.29 157.49,77.29 ; 206.64,295.64 207.96,296.96 210,296.96 213.77,293.19 213.77,291.18 v1(213.67,291.07) ; v1(262.6,356.32) 259.91,359 250.51,359 240.32,348.81 240.32,347.03 ; 55.89,229.69 63.33,229.69 65.35,231.7 v1(65.92,231.7) 66.44,231.7 67.54,230.6 68.63,230.6 v1(69.11,231.08) ; 157.49,26.49 164.93,26.49 166.95,28.5 v1(167.52,28.5) 168.04,28.5 169.14,27.4 170.23,27.4 v1(170.72,27.88) ; v1(119.91,281.88) 119.43,281.4 118.34,281.4 117.24,282.5 v1(116.72,282.5) 116.15,282.5 114.13,280.49 106.69,280.49 ; v1(119.91,180.28) 119.43,179.8 118.34,179.8 117.24,180.9 v1(116.72,180.9) 116.15,180.9 114.13,178.89 106.69,178.89 ; 87.92,42.23 87.92,44.01 98.11,54.2 107.51,54.2 v1(110.2,51.52) ; v1(161,203.92) 158.31,206.6 148.91,206.6 138.72,196.41 138.72,194.63 ; 55.89,26.49 63.33,26.49 65.35,28.5 v1(65.92,28.5) 66.44,28.5 67.54,27.4 68.63,27.4 v1(69.11,27.88) ; v1(170.72,180.28) 170.23,179.8 169.14,179.8 168.04,180.9 v1(167.52,180.9) 166.95,180.9 164.93,178.89 157.49,178.89 ; 157.49,280.49 164.93,280.49 166.95,282.5 v1(167.52,282.5) 168.04,282.5 169.14,281.4 170.23,281.4 v1(170.72,281.88) ; 259.09,331.29 266.53,331.29 268.55,333.3 v1(269.12,333.3) 269.64,333.3 270.74,332.2 271.83,332.2 v1(272.31,332.68) ; 138.72,347.03 138.72,348.81 148.91,359 158.31,359 v1(161,356.32) ; v1(313.4,356.32) 310.71,359 301.31,359 291.12,348.81 291.12,347.03 ; v1(315.27,138.67) 315.37,138.78 315.37,140.79 311.6,144.56 309.56,144.56 308.24,143.24 ; 240.32,93.03 240.32,94.81 250.51,105 259.91,105 v1(262.6,102.32) ; v1(315.27,341.88) 315.37,341.98 315.37,343.99 311.6,347.76 309.56,347.76 308.24,346.44 ; 291.12,245.43 291.12,247.21 301.31,257.4 310.71,257.4 v1(313.4,254.72) ; 155.84,194.04 157.16,195.36 159.2,195.36 162.97,191.59 162.97,189.58 v1(162.87,189.47) ; v1(313.4,153.12) 310.71,155.8 301.31,155.8 291.12,145.61 291.12,143.83 ; 257.44,244.84 258.76,246.16 260.8,246.16 264.57,242.39 264.57,240.38 v1(264.47,240.27) ; v1(221.52,231.08) 221.03,230.6 219.94,230.6 218.84,231.7 v1(218.32,231.7) 217.75,231.7 215.73,229.69 208.29,229.69 ; 257.44,92.44 258.76,93.76 260.8,93.76 264.57,89.99 264.57,87.98 v1(264.47,87.88) ; 105.04,346.44 106.36,347.76 108.4,347.76 112.17,343.99 112.17,341.98 v1(112.07,341.88) ; 208.29,280.49 215.73,280.49 217.75,282.5 v1(218.32,282.5) 218.84,282.5 219.94,281.4 221.03,281.4 v1(221.52,281.88) ; v1(162.87,138.67) 162.97,138.78 162.97,140.79 159.2,144.56 157.16,144.56 155.84,143.24 ; 257.44,41.64 258.76,42.96 260.8,42.96 264.57,39.19 264.57,37.18 v1(264.47,37.07) ; v1(119.91,129.48) 119.43,129 118.34,129 117.24,130.1 v1(116.72,130.1) 116.15,130.1 114.13,128.09 106.69,128.09 ; v1(112.07,87.88) 112.17,87.98 112.17,89.99 108.4,93.76 106.36,93.76 105.04,92.44 ; v1(272.31,281.88) 271.83,281.4 270.74,281.4 269.64,282.5 v1(269.12,282.5) 268.55,282.5 266.53,280.49 259.09,280.49 ; v1(211.8,153.12) 209.11,155.8 199.71,155.8 189.52,145.61 189.52,143.83 ; v1(61.27,138.67) 61.37,138.78 61.37,140.79 57.6,144.56 55.56,144.56 54.24,143.24 ; 155.84,346.44 157.16,347.76 159.2,347.76 162.97,343.99 162.97,341.98 v1(162.87,341.88) ; v1(112.07,189.47) 112.17,189.58 112.17,191.59 108.4,195.36 106.36,195.36 105.04,194.04 ; v1(272.31,180.28) 271.83,179.8 270.74,179.8 269.64,180.9 v1(269.12,180.9) 268.55,180.9 266.53,178.89 259.09,178.89